# EasyEDA Pro project rckid3_devboard.eprj, board RCKid
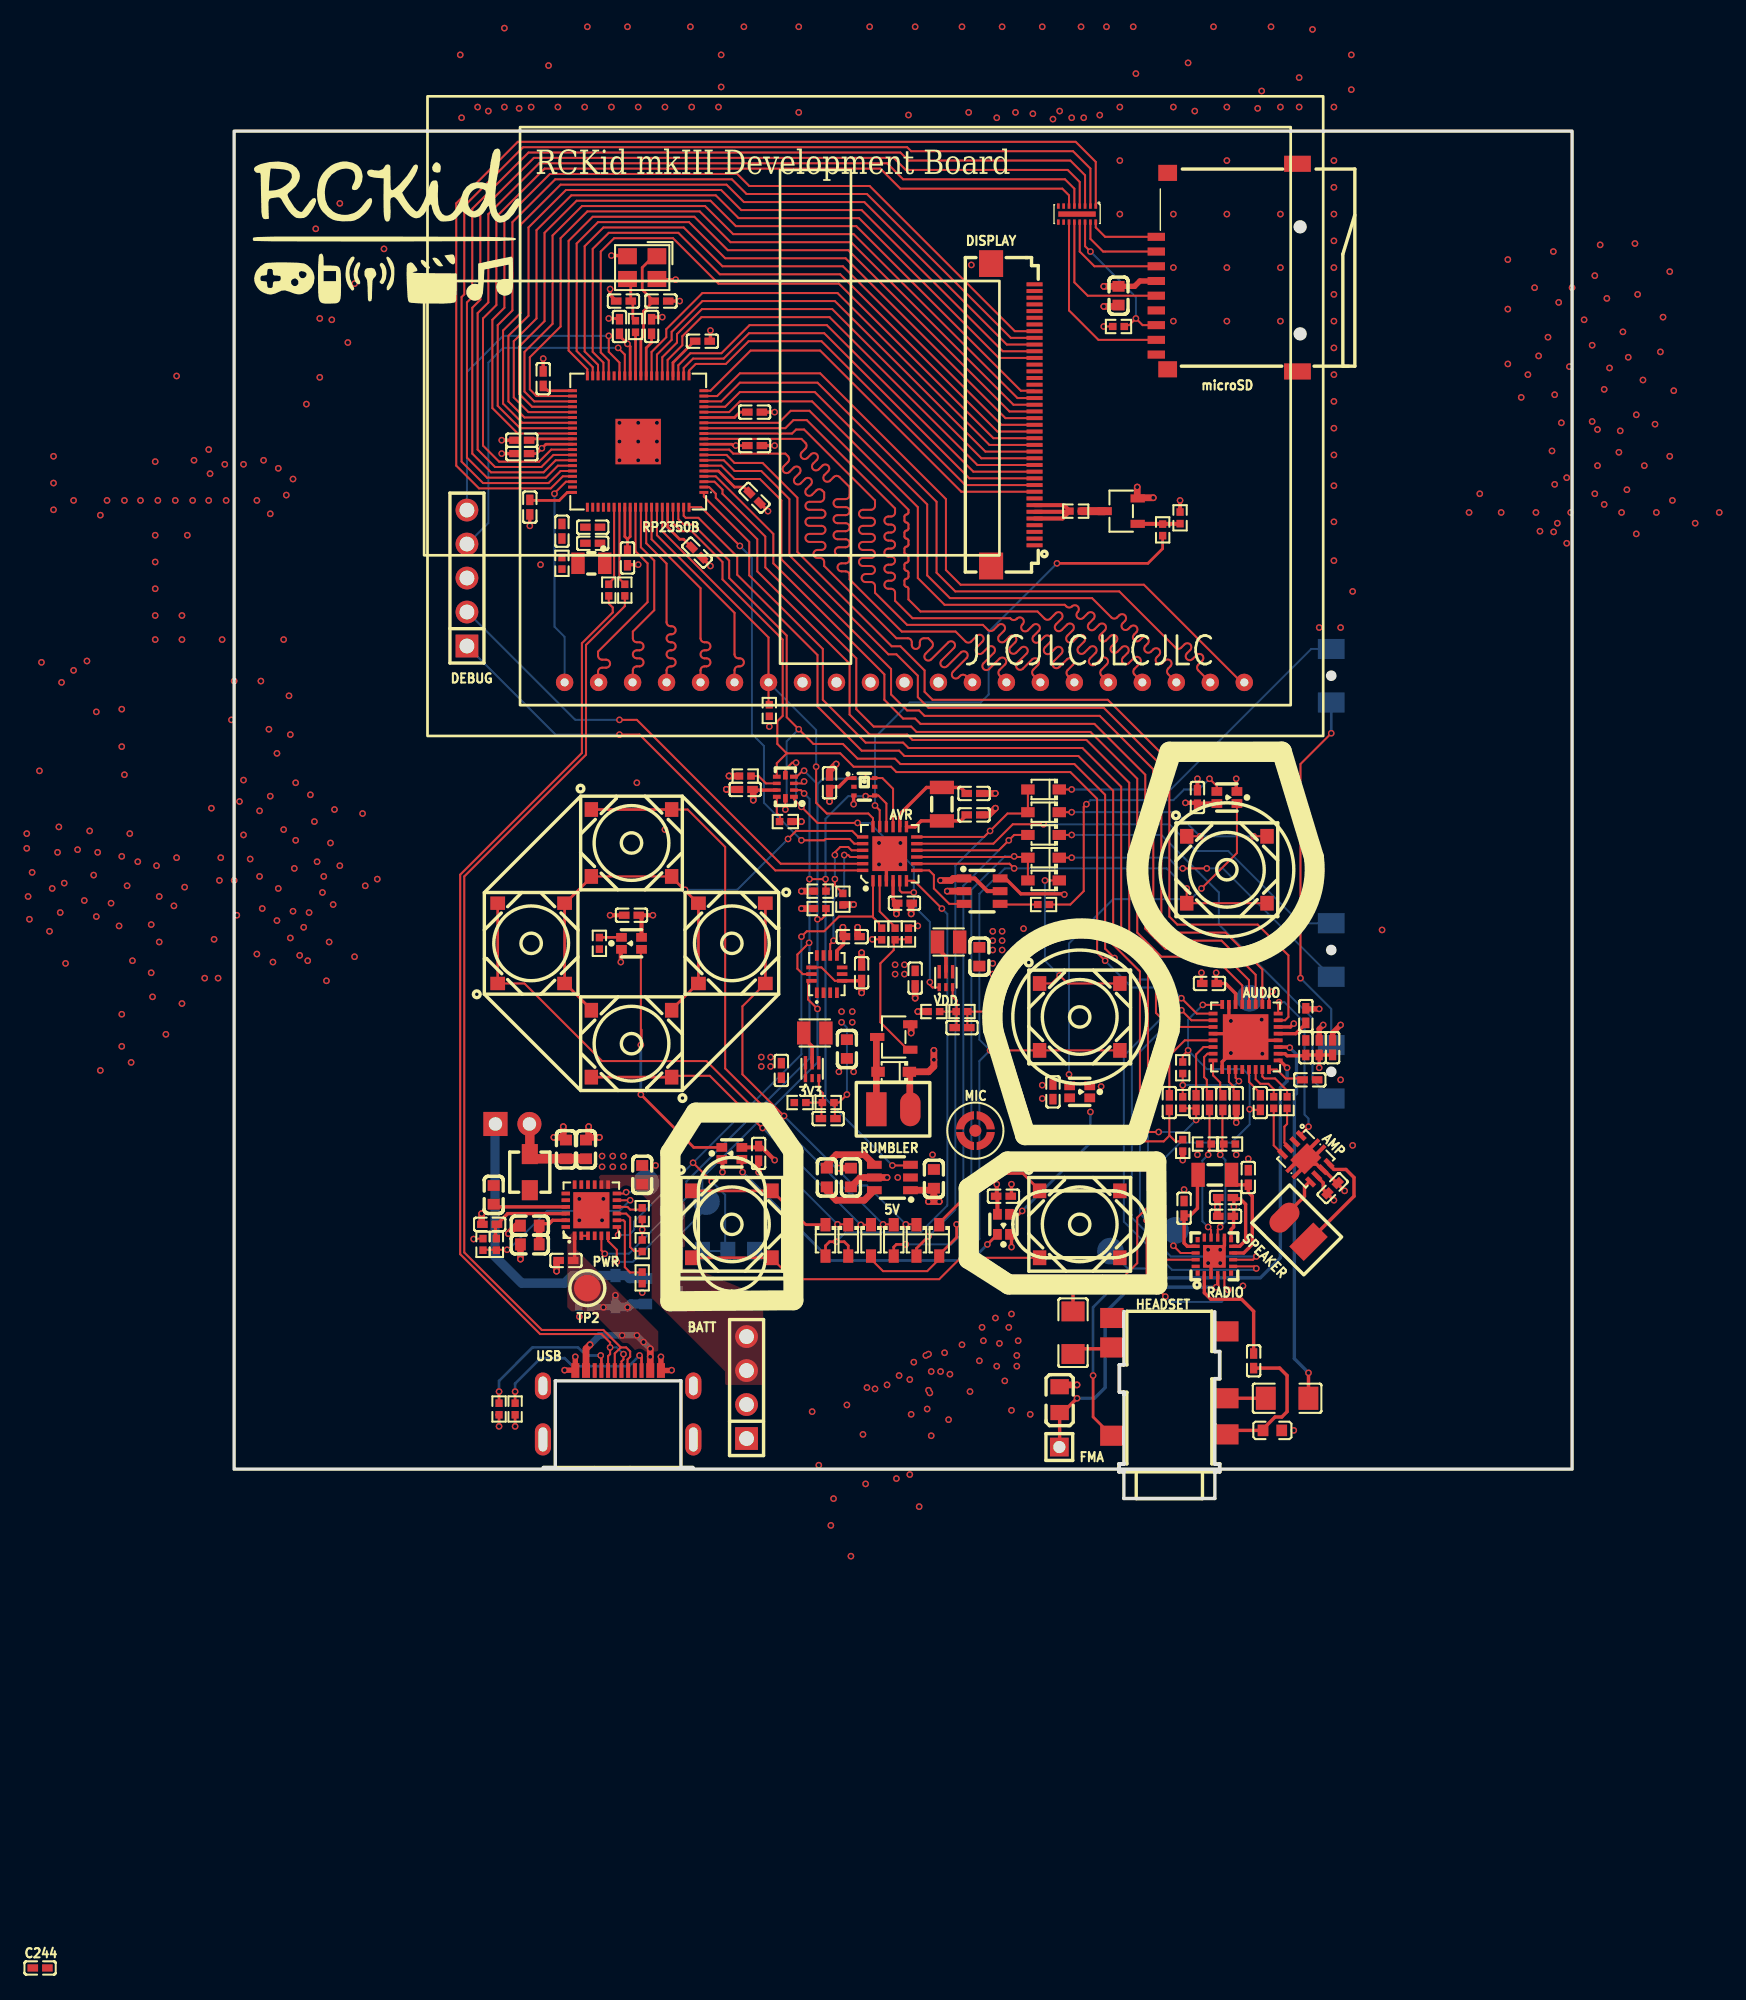
[diagram p19: board, top side]
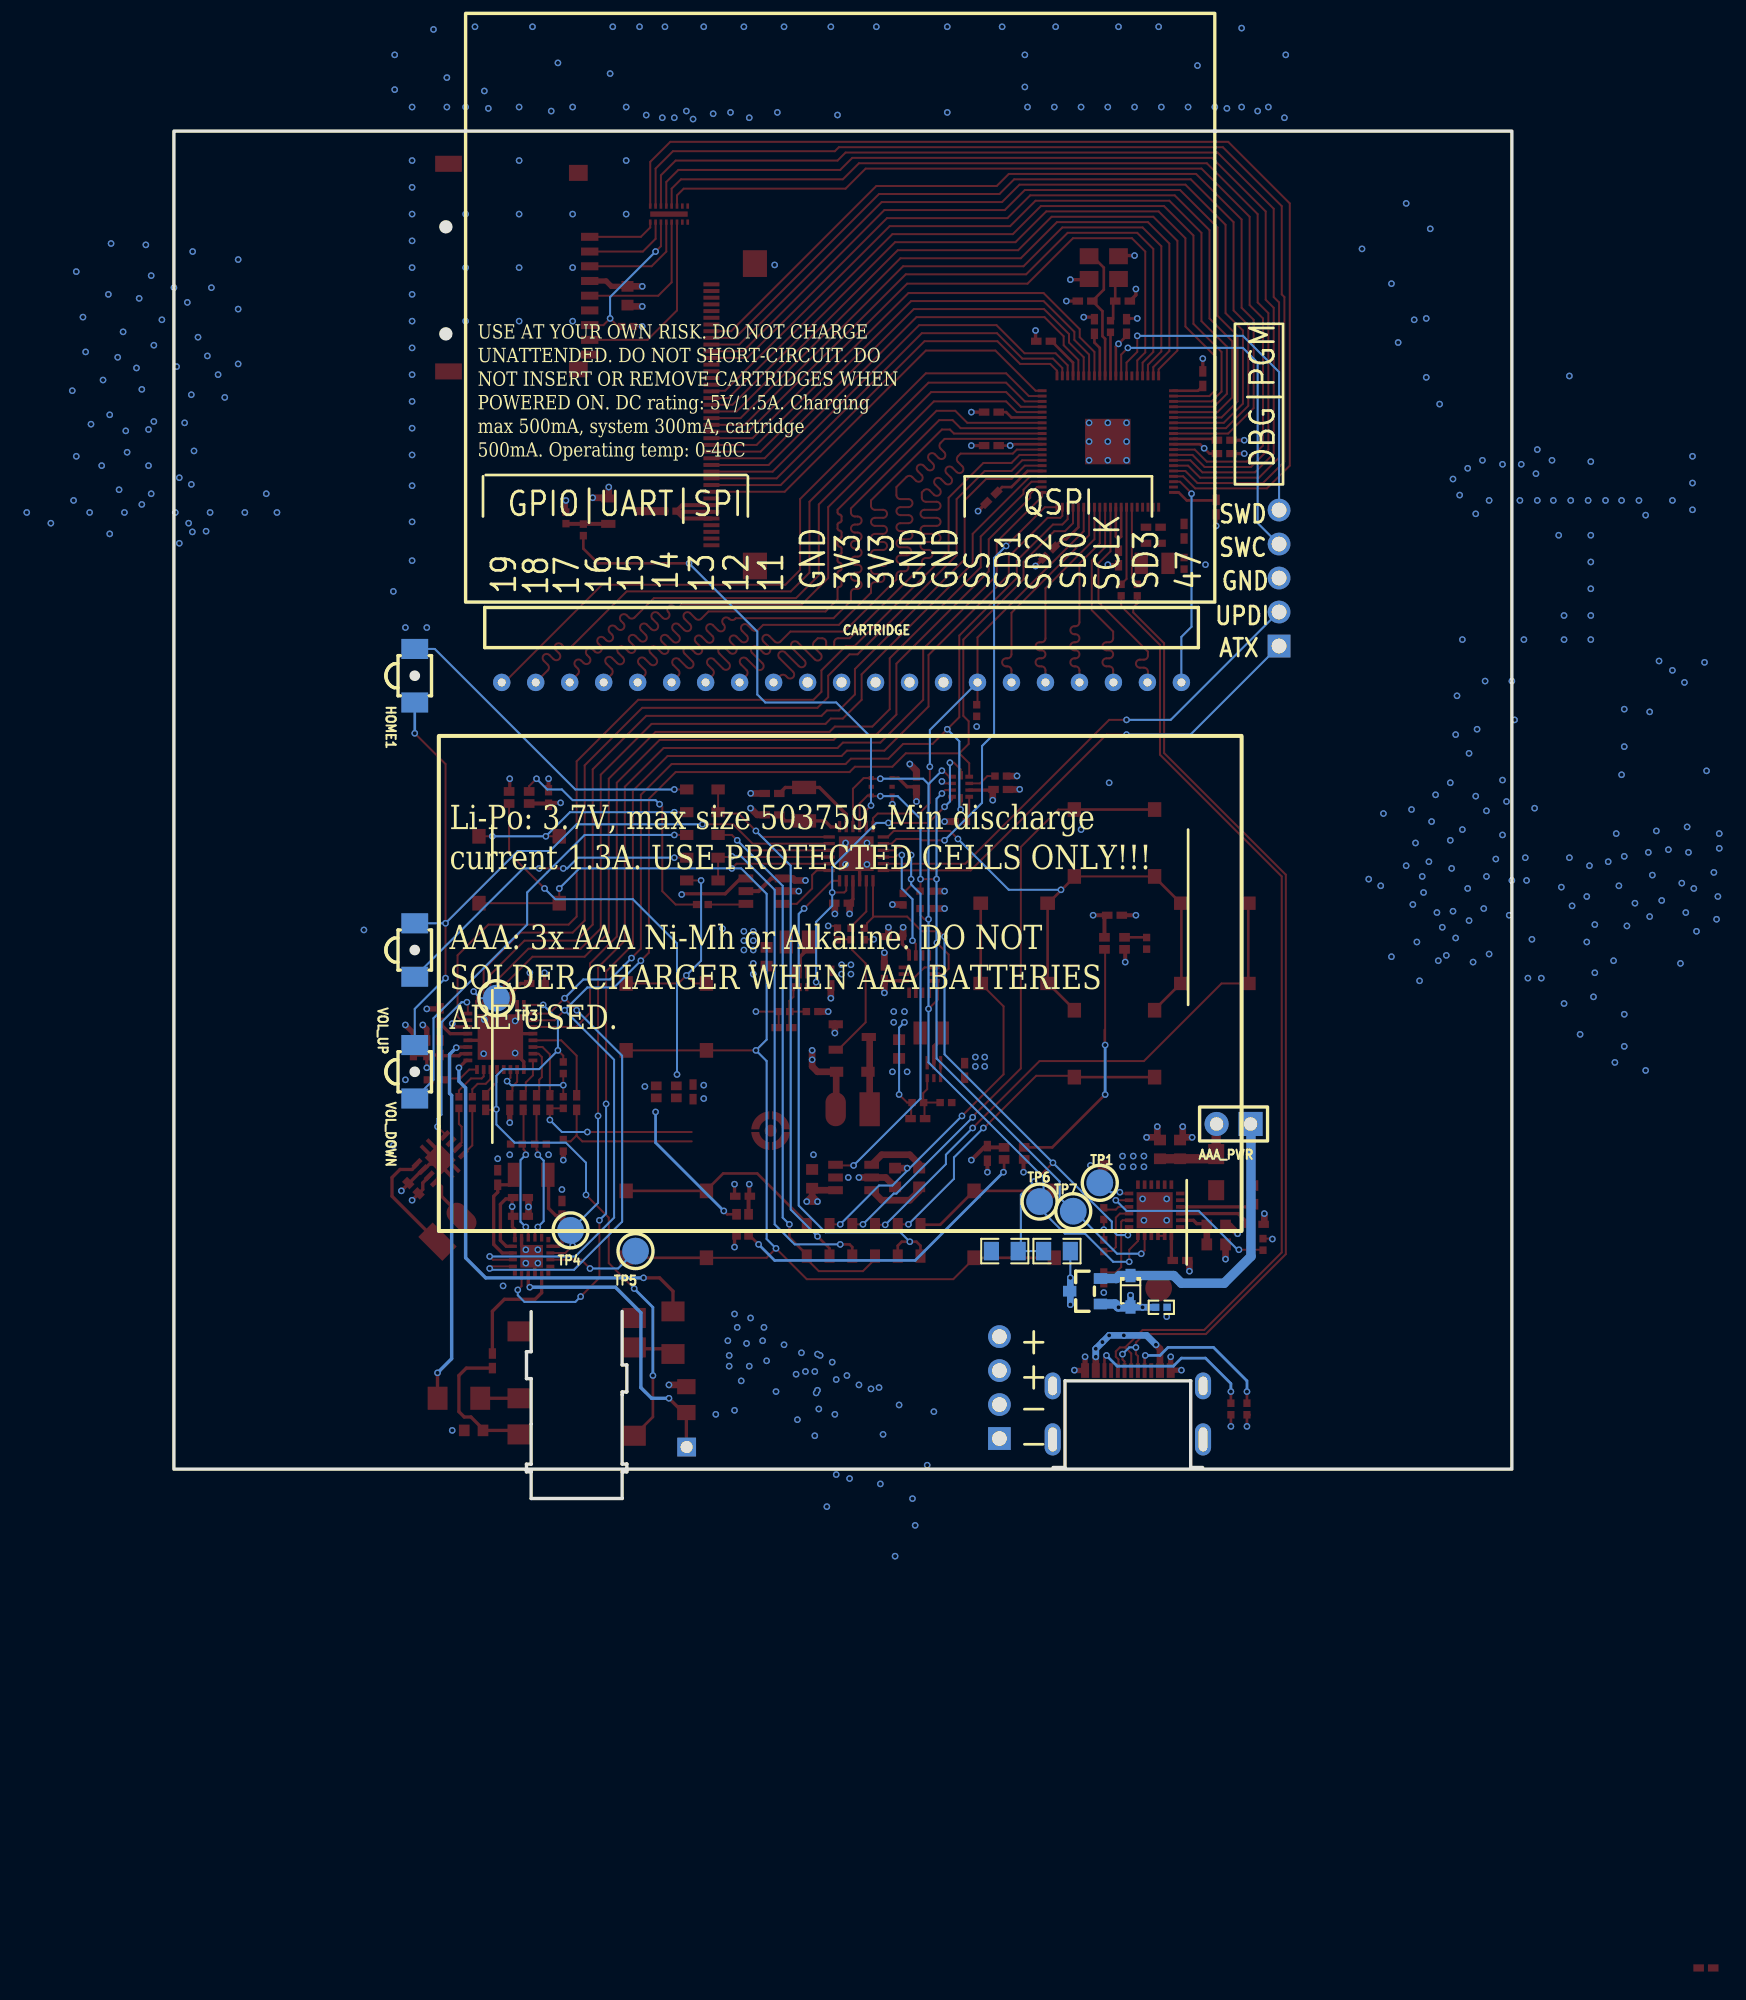
[diagram p20: board, bottom side, seen from below]

Outline 100 x 102.19 mm; copper layers: Top Layer, Inner1, Inner2, Bottom Layer. Coordinates in mm from the lower left corner of the outline.
Outline path: rectangle 0,102.19 100,2.19
Stack: Top Layer 0.035mm / Dielectric1 0.28mm PP er 4.5 / Inner1 0.035mm / Dielectric2 0.28mm FR4 er 4.5 / Inner2 0.035mm / Dielectric3 0.28mm PP er 4.5 / Bottom Layer 0.035mm

## Design rules (mm)
net USB_DM: DP1
net USB_DP: DP1
template: Custom Config
spacing copperThickness1oz (default): track to track 0.45, other pairs 0.127 to 0.3
spacing copperThickness2oz: track to track 0.203, other pairs 0.152 to 0.3
track width copperThickness1oz (default): min 0.127, default 0.254, max 2.54
track width copperThickness2oz: min 0.203, default 0.254, max 2.54
differential pair differentialPair (default): width min 0.127, default 0.254, max 2.54; gap min 0.152, default 0.152
via viaSize (default): diameter min 0.5, default 0.61, max 10; hole min 0.3, default 0.305, max 6.3
net 3V3 uses copperRegion1
net VUSB uses copperRegion1
net 5V uses copperRegion1
net VCC uses copperRegion1
net VBATT uses copperRegion1

## Placement (name value [footprint] x y rotation side)
3V3  TPS62825DMQT  [VSON-6_L1.5-W1.5-P0.50-TL]  43.2 31.99 90 top
5V  HX4002-MFC  [SOT-23-6_L2.9-W1.6-P0.95-LS2.8-BR]  49.2 23.99 0 top
A1  SKRRACE010  [KEY-SMD_4P-L7.5-W7.0-P5.00-TL]  63.2 35.99 0 top
AAA_PWR  -  [HDR-TH_2P-P2.54-V-M-1]  20.8 27.99 0 bottom
AMP  TPA2006D1DRBR  [VSON-8_L3.0-W3.0-P0.65-TL-EP]  80.1 25.39 315 top
AUDIO  TLV320AIC3204IRHBR  [QFN-32_L5.0-W5.0-P0.50-TL-EP3.4]  75.6 34.49 270 top
AVR  ATTINY3217-MFR  [WQFN-24_L4.0-W4.0-P0.50-TL-EP2.6]  49 48.19 90 top
B1  SKRRACE010  [KEY-SMD_4P-L7.5-W7.0-P5.00-TL]  74.2 46.99 0 top
B2  SKRRACE010  [KEY-SMD_4P-L7.5-W7.0-P5.00-TL]  63.2 20.49 0 top
B3  SKRRACE010  [KEY-SMD_4P-L7.5-W7.0-P5.00-TL]  37.2 20.49 0 top
BATT  -  [HDR-TH_4P-P2.54-V-M]  38.3 8.29 90 top
BOTTOM1  SKRRACE010  [KEY-SMD_4P-L7.5-W7.0-P5.00-TL]  37.2 41.49 270 top
C81  10uF  [C0603]  46.1 23.99 270 top
C82  10uF  [C0603]  52.3 23.89 270 top
C83  2.2uF  [C0603]  44.3 23.99 270 top
C95  100nF  [C0402]  46.9 39.29 270 top
C96  100nF  [C0402]  46.2 41.99 180 top
C101  100nF  [C0402]  61.2 30.39 270 top
C102  100nF  [C0402]  72 52.39 270 top
C104  100nF  [C0402]  29.7 43.59 0 top
C107  100nF  [C0402]  38.9 74.79 135 top
C108  100nF  [C0402]  34.6 70.69 135 top
C109  100nF  [C0402]  35 86.49 180 top
C110  100nF  [C0402]  21.5 79.09 0 top
C111  100nF  [C0402]  23.1 83.69 270 top
C112  100nF  [C0402]  38.9 81.19 180 top
C114  100nF  [C0402]  21.5 78.09 0 top
C115  1uF  [C0402]  38.9 78.69 180 top
C116  1uF  [C0402]  22.1 74.09 90 top
C117  100nF  [C0402]  31.2 87.59 270 top
C118  100nF  [C0402]  50.1 44.49 180 top
C132  22uF  [C0603]  66.1 89.89 90 top
C143  100nF  [C0402]  39.2 25.79 90 top
C144  100nF  [C0402]  57.5 22.59 180 top
C153  15pF  [C0402]  31.9 89.49 0 top
C154  15pF  [C0402]  29.1 89.49 180 top
C167  100nF  [C0402]  29.4 70.29 90 top
C191  100nF  [C0402]  80.1 33.69 270 top
C192  1uF  [C0402]  81.1 33.69 270 top
C199  220uF  [C1206]  62.7 12.39 90 top
C200  220uF  [C1206]  78.7 7.49 0 top
C201  10uF  [C0402]  74.9 29.59 270 top
C202  10uF  [C0402]  80.4 31.29 0 top
C203  10uF  [C0402]  80.1 36.09 90 top
C204  10uF  [C0402]  82.1 33.69 90 top
C205  100nF  [C0402]  71.9 29.59 270 top
C206  100nF  [C0402]  69.9 29.59 270 top
C207  100nF  [C0402]  76.7 29.59 270 top
C208  1uF  [C0402]  82.1 23.19 225 top
C209  1uF  [C0402]  72.9 38.49 0 top
C210  4.7uF  [C0402]  28.8 87.59 270 top
C211  4.7uF  [C0402]  26.8 72.59 0 top
C212  4.7uF  [C0402]  26.8 71.39 0 top
C213  4.7uF  [C0402]  24.5 72.29 90 top
C214  4.7uF  [C0402]  19.1 20.49 0 top
C215  22uF  [C0603]  22.1 20.39 0 top
C216  22uF  [C0603]  22.1 18.99 0 top
C218  1uF  [C0402]  24.8 17.79 0 top
C219  10uF  [C0603]  24.8 26.09 270 top
C220  10uF  [C0603]  26.3 26.09 270 top
C221  10uF  [C0603]  30.5 24.19 270 top
C224  4.7uF  [C0402]  40.9 31.99 90 top
C225  4.7uF  [C0402]  50.9 38.89 90 top
C228  22uF  [C0603]  45.8 33.59 90 top
C229  22uF  [C0603]  55.7 40.49 90 top
C230  120pF  [C0402]  44.4 28.39 0 top
C231  120pF  [C0402]  54.4 35.19 0 top
C232  120pF  [C0402]  55.3 51.09 180 top
C233  120pF  [C0402]  55.3 52.69 180 top
C234  100nF  [C0402]  38.2 52.99 0 top
C235  100nF  [C0402]  44.5 53.49 270 top
C236  22nF  [C0402]  74.1 21.09 0 top
C237  100nF  [C0402]  74.1 22.49 180 top
C238  120pF  [C0402]  75.8 23.99 90 top
C239  120pF  [C0402]  71 21.69 270 top
C240  100nF  [C0402]  72.9 29.59 90 top
C241  100nF  [C0402]  73.9 29.59 90 top
C242  100pF  [C0402]  76.2 10.29 90 top
C243  47nF  [C0603]  19.4 22.69 90 top
C244  100nF  [C0402]  -14.5 -35.08 0 top
CARTRIDGE  RCKid2 Cartridge Connector Female  [RCKID2 CARTRIDGE FEMALE]  50.1 60.99 180 bottom
D4  1N5819WS  [SOD-323_L1.8-W1.3-LS2.5-RD]  49.3 31.89 180 top
D5  1N5819WS  [SOD-323_L1.8-W1.3-LS2.5-RD]  51 19.29 270 top
D6  1N5819WS  [SOD-323_L1.8-W1.3-LS2.5-RD]  49.3 19.29 270 top
D7  1N5819WS  [SOD-323_L1.8-W1.3-LS2.5-RD]  47.6 19.29 270 top
D8  1N5819WS  [SOD-323_L1.8-W1.3-LS2.5-RD]  45.9 19.29 270 top
D9  1N5819WS  [SOD-323_L1.8-W1.3-LS2.5-RD]  60.5 51.29 180 top
D10  1N5819WS  [SOD-323_L1.8-W1.3-LS2.5-RD]  60.5 46.19 180 top
D11  1N5819WS  [SOD-323_L1.8-W1.3-LS2.5-RD]  52.7 19.29 270 top
D12  1N5819WS  [SOD-323_L1.8-W1.3-LS2.5-RD]  44.2 19.29 270 top
D14  1N5819WS  [SOD-323_L1.8-W1.3-LS2.5-RD]  60.5 47.89 180 top
D15  1N5819WS  [SOD-323_L1.8-W1.3-LS2.5-RD]  60.5 49.59 180 top
D16  BAT60JFILM  [SOD-323_L1.8-W1.3-LS2.5-RD]  28.5 15.49 270 bottom
D17  1N5819WS  [SOD-323_L1.8-W1.3-LS2.5-RD]  60.5 52.99 180 top
DEBUG  -  [HDR-TH_5P-P2.54-V-M]  17.4 68.79 90 top
DISPLAY  FPC-05FB-40PH20  [FPC-SMD_40P-P0.50_XUNPU_FPC-05FB-40PH20]  58.2 80.99 270 top
FMA  -  [HDR-TH_1P-V-M_XKB_X4611WV-01I-C28D40]  61.68 3.84 0 top
HEADSET  PJ-342D  [AUDIO-SMD_PJ-342D]  69.9 9.09 90 top
HOME1  B3U-3000PM-B  [key-smd_b3u-3000pm-b]  82 61.49 90 bottom
L15  IP4252CZ16-8-TTL,1  [UDFN-16_L3.3-W1.4-P0.40-BL-EP]  63 95.99 180 top
L16  AOTA-B201610S3R3-101-T  [IND-SMD_L2.0-W1.6_AOTA-B201610S3R3-101-T]  26.7 69.89 0 top
L17  2.2uH  [IND-SMD_L3.0-W3.0_IHLP-1212BZ]  22.1 24.39 90 top
L18  270nH  [L0603]  77.6 5.09 0 top
L19  120nH  [L0805]  61.7 7.39 90 top
LED7  XL-1615RGBC-WS2812B  [LED-SMD_4P-L1.6-W1.5_XL-1615RGBC-WS2812B]  63.2 30.39 180 top
LED8  XL-1615RGBC-WS2812B  [LED-SMD_4P-L1.6-W1.5_XL-1615RGBC-WS2812B]  74.2 52.39 180 top
LED10  XL-1615RGBC-WS2812B  [LED-SMD_4P-L1.6-W1.5_XL-1615RGBC-WS2812B]  29.7 41.49 0 top
LED11  XL-1615RGBC-WS2812B  [LED-SMD_4P-L1.6-W1.5_XL-1615RGBC-WS2812B]  37.2 25.79 0 top
LED12  XL-1615RGBC-WS2812B  [LED-SMD_4P-L1.6-W1.5_XL-1615RGBC-WS2812B]  57.5 20.49 90 top
LEFT1  SKRRACE010  [KEY-SMD_4P-L7.5-W7.0-P5.00-TL]  29.7 48.99 0 top
MIC  B4013AM422-42  [MIC-SMD_BD4.0_B4013AM423-008]  55.4 27.49 0 top
microSD  TF-01A  [TF-SMD_TF-01A]  74.2 91.99 90 top
PWR  -  [QFN-24_L4.0-W4.0-P0.50-TL-EP2.7]  26.7 21.54 90 top
Q6  AO3400A  [SOT-23-3_L2.9-W1.6-P1.90-LS2.8-BR]  66.3 73.79 0 top
Q8  AO3401A  [SOT-23_L2.9-W1.3-P1.90-LS2.4-BR]  31.9 15.49 180 bottom
Q9  AO3400A  [SOT-23-3_L2.9-W1.6-P1.90-LS2.8-BR]  49.3 34.49 0 top
R45  2.2kΩ  [R0402]  43.8 45.39 180 top
R46  2.2kΩ  [R0402]  43.8 44.09 180 top
R48  10kΩ  [R0402]  45.5 44.79 270 top
R50  22Ω  [R0402]  28 67.89 90 top
R51  22Ω  [R0402]  29.2 67.89 90 top
R52  10kΩ  [R0402]  26.2 14.29 0 bottom
R54  10kΩ  [R0402]  50.4 42.19 90 top
R55  10kΩ  [R0402]  70.7 73.29 90 top
R56  10kΩ  [R0402]  40 58.89 270 top
R57  5.1kΩ  [R0402]  21 6.69 270 top
R58  5.1kΩ  [R0402]  19.8 6.69 270 top
R76  10kΩ  [R0402]  66.1 87.59 0 top
R84  5.11Ω  [R0402]  62.9 73.79 0 top
R87  470Ω  [R0402]  60.5 44.39 0 top
R88  470Ω  [R0402]  27.3 41.49 270 top
R91  1kΩ  [R0402]  49.4 42.19 90 top
R92  1kΩ  [R0402]  69.4 72.39 270 top
R93  1kΩ  [R0402]  30 87.59 90 top
R103  1kΩ  [R0402]  70.9 29.59 90 top
R104  1kΩ  [R0402]  70.9 26.39 90 top
R105  220kΩ  [R0402]  77.7 29.59 270 top
R106  220kΩ  [R0402]  78.7 29.59 270 top
R109  33Ω  [R0402]  24.5 69.89 90 top
R110  10kΩ  [R0402]  30.5 18.89 90 top
R111  10kΩ  [R0402]  30.5 16.49 270 top
R112  10kΩ  [R0402]  19.6 18.99 270 top
R113  10kΩ  [R0402]  18.6 18.99 90 top
R115  100kΩ  [R0402]  42.3 29.59 0 top
R116  100kΩ  [R0402]  52.3 36.39 0 top
R117  450kΩ  [R0402]  44.4 29.59 0 top
R118  450kΩ  [R0402]  54.4 36.39 0 top
R119  10kΩ  [R0402]  41.2 50.59 0 top
R120  10kΩ  [R0402]  38.2 53.99 180 top
R121  10kΩ  [R0402]  74.4 26.49 0 top
R122  10kΩ  [R0402]  72.6 26.49 180 top
R123  2.7kΩ  [R0402]  70.9 32.19 270 top
R124  10kΩ  [R0402]  48.4 42.19 270 top
R125  24kΩ  [R0402]  30.5 21.29 270 top
R126  300kΩ  [R0805]  34 18.49 180 bottom
R127  570k  [R0805]  37.9 18.49 180 bottom
RADIO  SI4705-D60-GMR  [QFN-20_L3.0-W3.0-P0.50-TL-EP1.7_SILICON-LABS_SI4X55]  73.27 18.1 90 top
RIGHT1  SKRRACE010  [KEY-SMD_4P-L7.5-W7.0-P5.00-TL]  29.7 33.99 180 top
RP2350B  RP2350B  [QFN-80_L10.0-W10.0-P0.40-TL-EP3.4]  30.2 78.99 180 top
RUMBLER  -  [SMT wire pad (2)]  48 29.09 90 top
SPEAKER  -  [SMT wire pad (2)]  80.3 19.19 225 top
TOP1  SKRRACE010  [KEY-SMD_4P-L7.5-W7.0-P5.00-TL]  22.2 41.49 90 top
TP1  -  [TESTPOINT-SMD_BD1.5_P70-5000045R]  30.8 23.59 180 bottom
TP2  -  [TESTPOINT-SMD_BD1.5_P70-5000045R]  26.4 15.72 0 top
TP3  -  [TESTPOINT-SMD_BD1.5_P70-5000045R]  75.9 37.39 180 bottom
TP4  -  [TESTPOINT-SMD_BD1.5_P70-5000045R]  70.35 20.04 180 bottom
TP5  -  [TESTPOINT-SMD_BD1.5_P70-5000045R]  65.5 18.49 180 bottom
TP6  -  [TESTPOINT-SMD_BD1.5_P70-5000045R]  35.3 22.19 180 bottom
TP7  -  [TESTPOINT-SMD_BD1.5_P70-5000045R]  32.78 21.47 180 bottom
U26  BMI160  [LGA-14_L3.0-W2.5-P0.50-BL]  44.3 39.19 0 top
U33  SN74LVC1T45DBVR  [SOT-23-6_L2.9-W1.6-P0.95-LS2.8-BR]  55.9 45.39 180 top
U39  ABM8-272-T3  [CRYSTAL-SMD_4P-L3.2-W2.5-BL]  30.5 91.99 180 top
U40  TS5A23159RSER  [UQFN-10_L2.0-W1.5-P0.50-BL-EP]  41.2 53.19 90 top
U41  LTR-390UV-01  [SENSOR-SMD_LTR-390UV-01]  47.1 53.19 270 top
USB  TYPE-C-F02C-1BBWC1.6  [USB-C-SMD_TYPE-C-F02C-1BBWC1.6]  28.7 6.99 0 top
USB1  470nH  [IND-SMD_L2.0-W1.6]  43.4 34.79 180 top
USB2  470nH  [IND-SMD_L2.0-W1.6]  53.4 41.59 180 top
VDD  TPS62825DMQT  [VSON-6_L1.5-W1.5-P0.50-TL]  53.2 38.79 90 top
VOL_DOWN  B3U-3000PM-B  [key-smd_b3u-3000pm-b]  82 31.89 90 bottom
VOL_UP  B3U-3000PM-B  [key-smd_b3u-3000pm-b]  82 40.99 90 bottom
X1  32.768kHz  [FC-135R_L3.2-W1.5]  52.9 51.89 90 top
X2  32.768kHz  [FC-135R_L3.2-W1.5]  73.3 24.19 180 top

## Footprints (pads in the part's own frame, mm; a bottom-side part is the same pattern mirrored in y, then rotated)
AUDIO-SMD_PJ-342D
  rect 1.5x1.75 smd: 1(-4.3,-4.295) 2(-4.4,4.295) 3(-1.6,-4.295) 4(2.2,4.295) 5(4.4,4.295) 6(3.4,-4.295)
C0402
  rect 0.79x0.54 smd: 1(-0.545,0) 2(0.545,0)
C0603
  rect 0.8x0.9 smd: 1(-0.7,0) 2(0.7,0)
C1206
  rect 1.485x1.728 smd: 1(-1.593,0) 2(1.593,0)
CRYSTAL-SMD_4P-L3.2-W2.5-BL
  rect 1.4x1.2 smd: 1(-1.1,-0.85) 2(1.1,-0.85) 3(1.1,0.85) 4(-1.1,0.85)
FC-135R_L3.2-W1.5
  rect 1x1.8 smd: 1(-1.25,0) 2(1.25,0)
FPC-SMD_40P-P0.50_XUNPU_FPC-05FB-40PH20
  rect 0.3x1.2 smd: 1(9.75,1.625) 2(9.25,1.625) 3(8.75,1.625) 4(8.25,1.625) 5(7.75,1.625) 6(7.25,1.625) 7(6.75,1.625) 8(6.25,1.625) 9(5.75,1.625) 10(5.25,1.625) 11(4.75,1.625) 12(4.25,1.625) 13(3.75,1.625) 14(3.25,1.625) 15(2.75,1.625) 16(2.25,1.625) 17(1.75,1.625) 18(1.25,1.625) 19(0.75,1.625) 20(0.25,1.625) 21(-0.25,1.625) 22(-0.75,1.625) 23(-1.25,1.625) 24(-1.75,1.625) 25(-2.25,1.625) 26(-2.75,1.625) 27(-3.25,1.625) 28(-3.75,1.625) 29(-4.25,1.625) 30(-4.75,1.625) 31(-5.25,1.625) 32(-5.75,1.625) 33(-6.25,1.625) 34(-6.75,1.625) 35(-7.25,1.625) 36(-7.75,1.625) 37(-8.25,1.625) 38(-8.75,1.625) 39(-9.25,1.625) 40(-9.75,1.625)
  rect 2x1.8 smd: 41(-11.3,-1.625) 42(11.3,-1.625)
HDR-TH_1P-V-M_XKB_X4611WV-01I-C28D40
  rect 1.4x1.4 hole 0.9: 1(0,0)
HDR-TH_2P-P2.54-V-M-1
  rect 1.8x1.8 hole 1: 1(-1.27,0)
  round 1.8 hole 1: 2(1.27,0)
HDR-TH_4P-P2.54-V-M
  rect 1.7x1.7 hole 1.1: 1(-3.81,0)
  round 1.7 hole 1.1: 2(-1.27,0) 3(1.27,0) 4(3.81,0)
HDR-TH_5P-P2.54-V-M
  rect 1.7x1.7 hole 1.1: 1(-5.08,0)
  round 1.7 hole 1.1: 2(-2.54,0) 3(0,0) 4(2.54,0) 5(5.08,0)
IND-SMD_L2.0-W1.6
  rect 1x1.72 smd: 1(0.828,0) 2(-0.828,0)
IND-SMD_L2.0-W1.6_AOTA-B201610S3R3-101-T
  rect 1x1.6 smd: 1(-1,0) 2(1,0)
IND-SMD_L3.0-W3.0_IHLP-1212BZ
  rect 1.5x1.2 smd: 1(-1.35,0) 2(1.35,0)
KEY-SMD_4P-L7.5-W7.0-P5.00-TL
  rect 1x1.1 smd: 1(-3,2.5) 2(-3,-2.5) 3(3,2.5) 4(3,-2.5)
key-smd_b3u-3000pm-b
  rect 1.5x2 smd: 1(-2,0) 2(2,0)
L0603
  rect 0.8x0.864 smd: 1(-0.7,0) 2(0.7,0)
L0805
  rect 1.133x1.377 smd: 1(-0.966,0) 2(0.966,0)
LED-SMD_4P-L1.6-W1.5_XL-1615RGBC-WS2812B
  rect 0.8x0.65 smd: 1(-0.75,0.45) 2(0.75,0.45) 3(-0.75,-0.45) 4(0.75,-0.45)
LGA-14_L3.0-W2.5-P0.50-BL
  rect 0.28x0.785 smd: 1(-0.75,-1.393) 2(-0.25,-1.393) 3(0.25,-1.393) 4(0.75,-1.393) 8(0.75,1.393) 9(0.25,1.393) 10(-0.25,1.393) 11(-0.75,1.393)
  rect 0.785x0.28 smd: 5(1.143,-0.5) 6(1.143,0) 7(1.143,0.5) 12(-1.143,0.5) 13(-1.143,0) 14(-1.143,-0.5)
MIC-SMD_BD4.0_B4013AM423-008
  round 0.9 smd: 1(0,0)
  custom 1.35x1.35 smd: 2(-0.798,0.775) 2(-0.775,-0.798) 2(0.775,0.798) 2(0.798,-0.775)
QFN-20_L3.0-W3.0-P0.50-TL-EP1.7_SILICON-LABS_SI4X55
  rect 0.4x0.3 smd: 1(-1.25,1.25) 6(-1.25,-1.25) 11(1.25,-1.25) 16(1.25,1.25)
  rect 0.6x0.25 smd: 2(-1.4,0.75) 3(-1.4,0.25) 4(-1.4,-0.25) 5(-1.4,-0.75) 12(1.4,-0.75) 13(1.4,-0.25) 14(1.4,0.25) 15(1.4,0.75)
  rect 0.25x0.6 smd: 7(-0.75,-1.4) 8(-0.25,-1.4) 9(0.25,-1.4) 10(0.75,-1.4) 17(0.75,1.4) 18(0.25,1.4) 19(-0.25,1.4) 20(-0.75,1.4)
  rect 1.7x1.7 smd: 21(0,0)
QFN-24_L4.0-W4.0-P0.50-TL-EP2.7
  rect 0.633x0.28 smd: 1(-1.911,1.25) 2(-1.911,0.75) 3(-1.911,0.25) 4(-1.911,-0.25) 5(-1.911,-0.75) 6(-1.911,-1.25) 13(1.911,-1.25) 14(1.911,-0.75) 15(1.911,-0.25) 16(1.911,0.25) 17(1.911,0.75) 18(1.911,1.25)
  rect 0.28x0.633 smd: 7(-1.25,-1.911) 8(-0.75,-1.911) 9(-0.25,-1.911) 10(0.25,-1.911) 11(0.75,-1.911) 12(1.25,-1.911) 19(1.25,1.911) 20(0.75,1.911) 21(0.25,1.911) 22(-0.25,1.911) 23(-0.75,1.911) 24(-1.25,1.911)
  rect 2.7x2.7 smd: 25(0,0)
QFN-32_L5.0-W5.0-P0.50-TL-EP3.4
  rect 0.665x0.28 smd: 1(-2.433,1.75) 2(-2.433,1.25) 3(-2.433,0.75) 4(-2.433,0.25) 5(-2.433,-0.25) 6(-2.433,-0.75) 7(-2.433,-1.25) 8(-2.433,-1.75) 17(2.433,-1.75) 18(2.433,-1.25) 19(2.433,-0.75) 20(2.433,-0.25) 21(2.433,0.25) 22(2.433,0.75) 23(2.433,1.25) 24(2.433,1.75)
  rect 0.28x0.665 smd: 9(-1.75,-2.433) 10(-1.25,-2.433) 11(-0.75,-2.433) 12(-0.25,-2.433) 13(0.25,-2.433) 14(0.75,-2.433) 15(1.25,-2.433) 16(1.75,-2.433) 25(1.75,2.433) 26(1.25,2.433) 27(0.75,2.433) 28(0.25,2.433) 29(-0.25,2.433) 30(-0.75,2.433) 31(-1.25,2.433) 32(-1.75,2.433)
  rect 3.4x3.4 smd: 33(0,0)
QFN-80_L10.0-W10.0-P0.40-TL-EP3.4
  rect 0.665x0.22 smd: 1(-4.907,3.8) 2(-4.907,3.4) 3(-4.907,3) 4(-4.907,2.6) 5(-4.907,2.2) 6(-4.907,1.8) 7(-4.907,1.4) 8(-4.907,1) 9(-4.907,0.6) 10(-4.907,0.2) 11(-4.907,-0.2) 12(-4.907,-0.6) 13(-4.907,-1) 14(-4.907,-1.4) 15(-4.907,-1.8) 16(-4.907,-2.2) 17(-4.907,-2.6) 18(-4.907,-3) 19(-4.907,-3.4) 20(-4.907,-3.8) 41(4.907,-3.8) 42(4.907,-3.4) 43(4.907,-3) 44(4.907,-2.6) 45(4.907,-2.2) 46(4.907,-1.8) 47(4.907,-1.4) 48(4.907,-1) 49(4.907,-0.6) 50(4.907,-0.2) 51(4.907,0.2) 52(4.907,0.6) 53(4.907,1) 54(4.907,1.4) 55(4.907,1.8) 56(4.907,2.2) 57(4.907,2.6) 58(4.907,3) 59(4.907,3.4) 60(4.907,3.8)
  rect 0.22x0.665 smd: 21(-3.8,-4.907) 22(-3.4,-4.907) 23(-3,-4.907) 24(-2.6,-4.907) 25(-2.2,-4.907) 26(-1.8,-4.907) 27(-1.4,-4.907) 28(-1,-4.907) 29(-0.6,-4.907) 30(-0.2,-4.907) 31(0.2,-4.907) 32(0.6,-4.907) 33(1,-4.907) 34(1.4,-4.907) 35(1.8,-4.907) 36(2.2,-4.907) 37(2.6,-4.907) 38(3,-4.907) 39(3.4,-4.907) 40(3.8,-4.907) 61(3.8,4.907) 62(3.4,4.907) 63(3,4.907) 64(2.6,4.907) 65(2.2,4.907) 66(1.8,4.907) 67(1.4,4.907) 68(1,4.907) 69(0.6,4.907) 70(0.2,4.907) 71(-0.2,4.907) 72(-0.6,4.907) 73(-1,4.907) 74(-1.4,4.907) 75(-1.8,4.907) 76(-2.2,4.907) 77(-2.6,4.907) 78(-3,4.907) 79(-3.4,4.907) 80(-3.8,4.907)
  rect 3.4x3.4 smd: 81(0,0)
R0402
  rect 0.566x0.54 smd: 1(-0.433,0) 2(0.433,0)
R0805
  rect 1.133x1.377 smd: 1(-1,0) 2(1,0)
RCKID2 CARTRIDGE FEMALE
  round 1.3 hole 0.6: 1(-25.4,0) 2(-22.86,0) 3(-20.32,0.003) 4(-17.78,0.003) 5(-15.24,0.003) 6(-12.7,0.003) 7(-10.16,0.003) 8(-7.62,0.003) 9(-5.08,0.003) 15(10.16,0.003) 16(12.7,0.003) 17(15.24,0.003) 18(17.78,0.003) 19(20.32,0.003) 20(22.86,0.003) 21(25.4,0.003)
  round 1.3 hole 0.762x0.6: 10(-2.54,0.003) 11(0,0.003) 12(2.54,0.003) 13(5.08,0.003) 14(7.62,0.003)
SENSOR-SMD_LTR-390UV-01
  rect 0.3x0.4 smd: 1(-0.65,-0.775) 2(0,-0.775) 3(0.65,-0.775) 4(0.65,0.775) 5(0,0.775) 6(-0.65,0.775)